# EasyEDA Pro project test_0.eprj

# Schematic Schematic1

## Sheets
1 P1: Board Name: Board1; Create Date: 2024-12-12; Page Name: P1; Project Name: test_0; Schematic Name: Schematic1; Update Date: 2025-06-09; Company: 嘉立创EDA; Page Size: A4; Version: V1.0
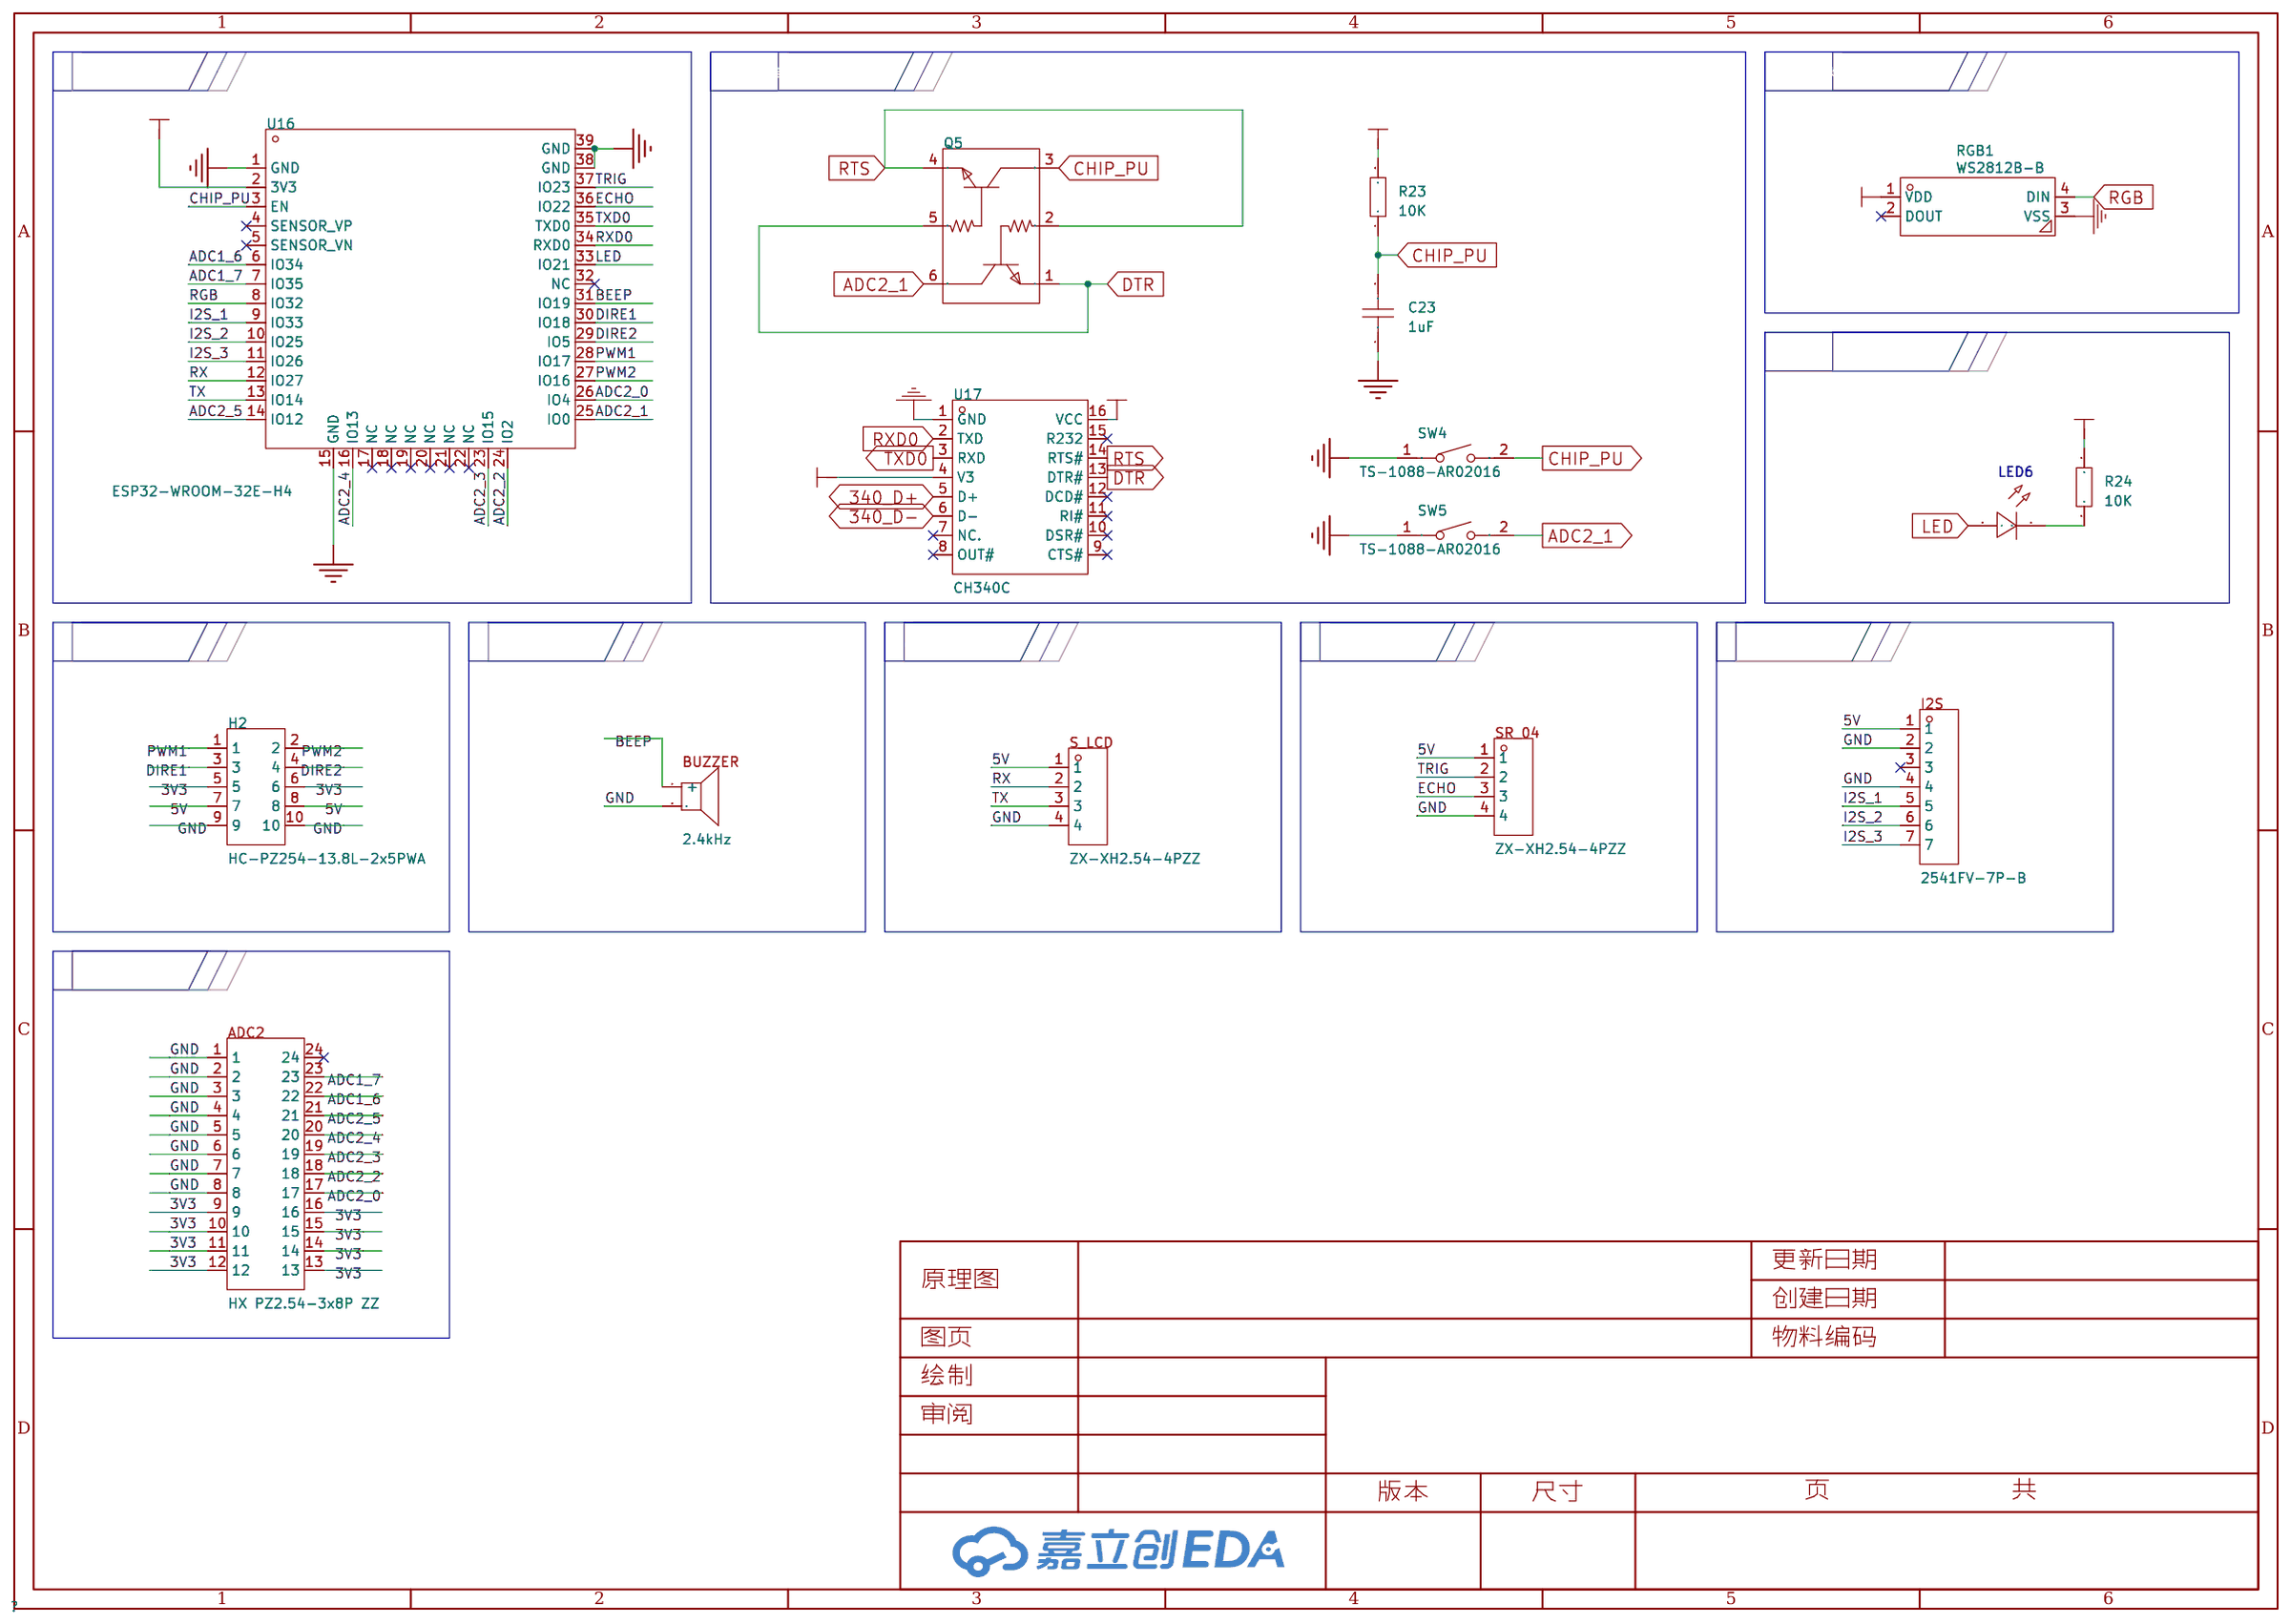
[diagram p0: P1]
2 P2: Create Date: 2024-12-15; Page Name: P2
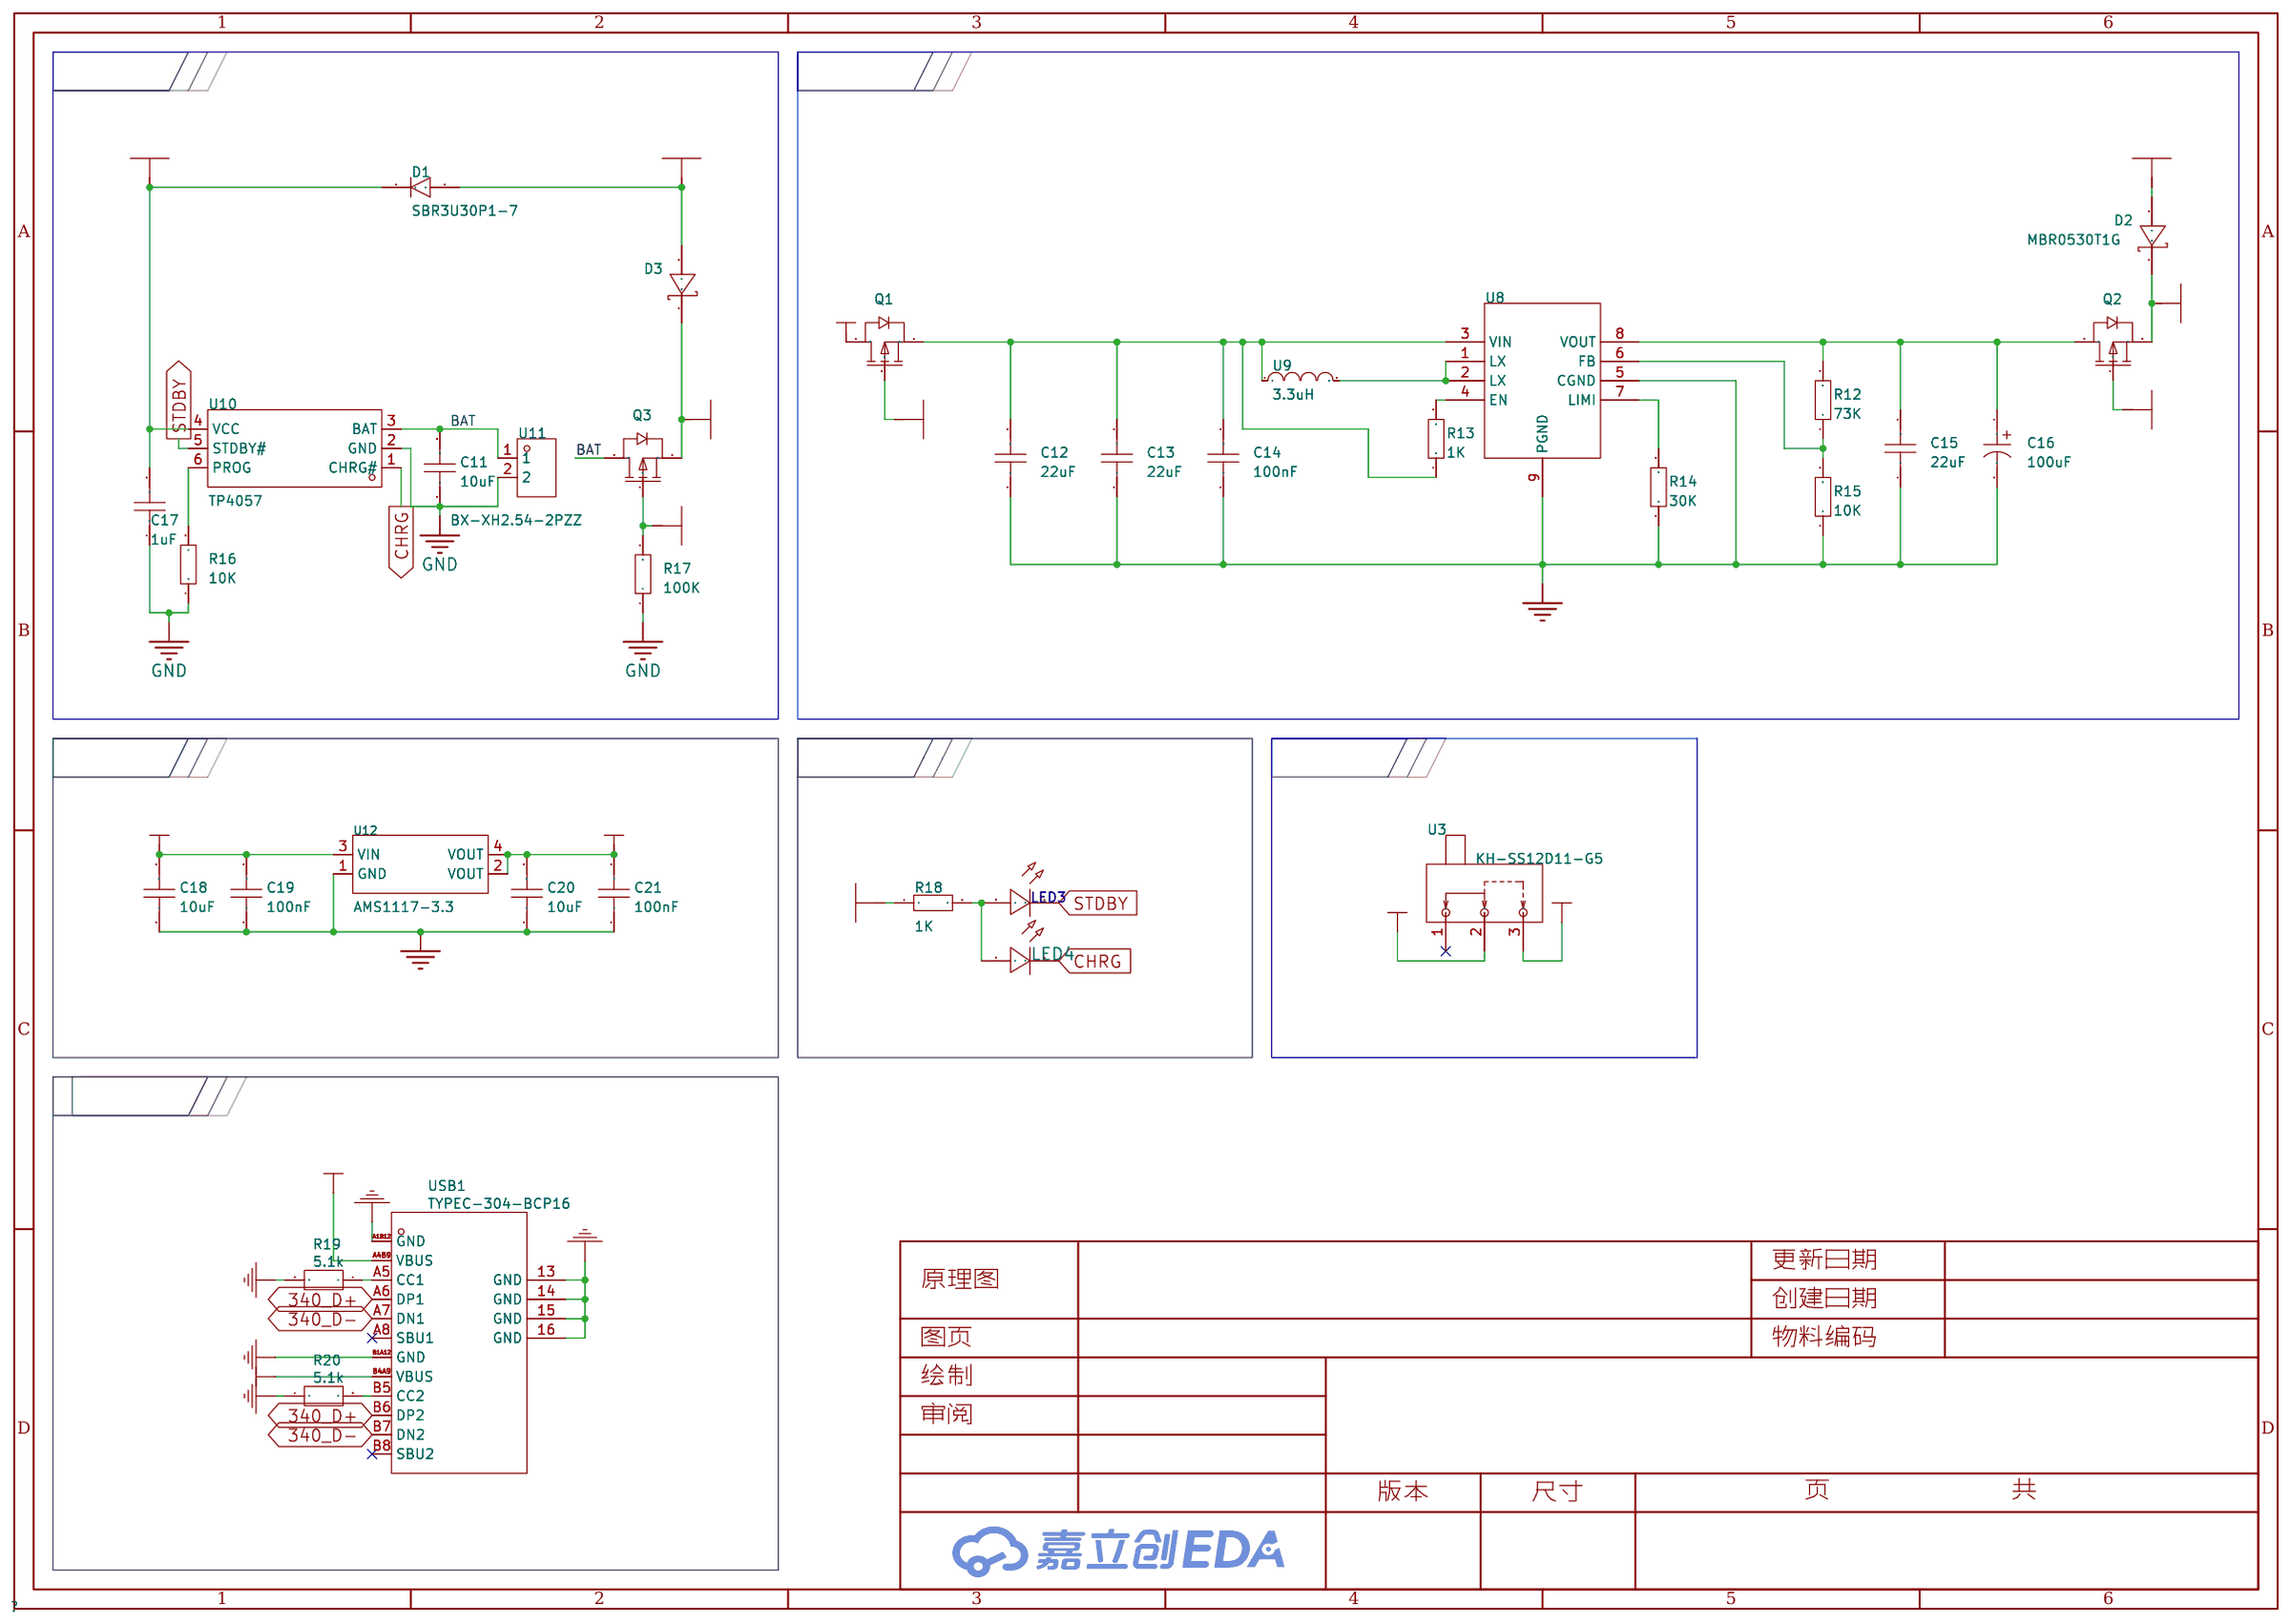
[diagram p1: P2]
3 P3: Create Date: 2025-01-15; Page Name: P3
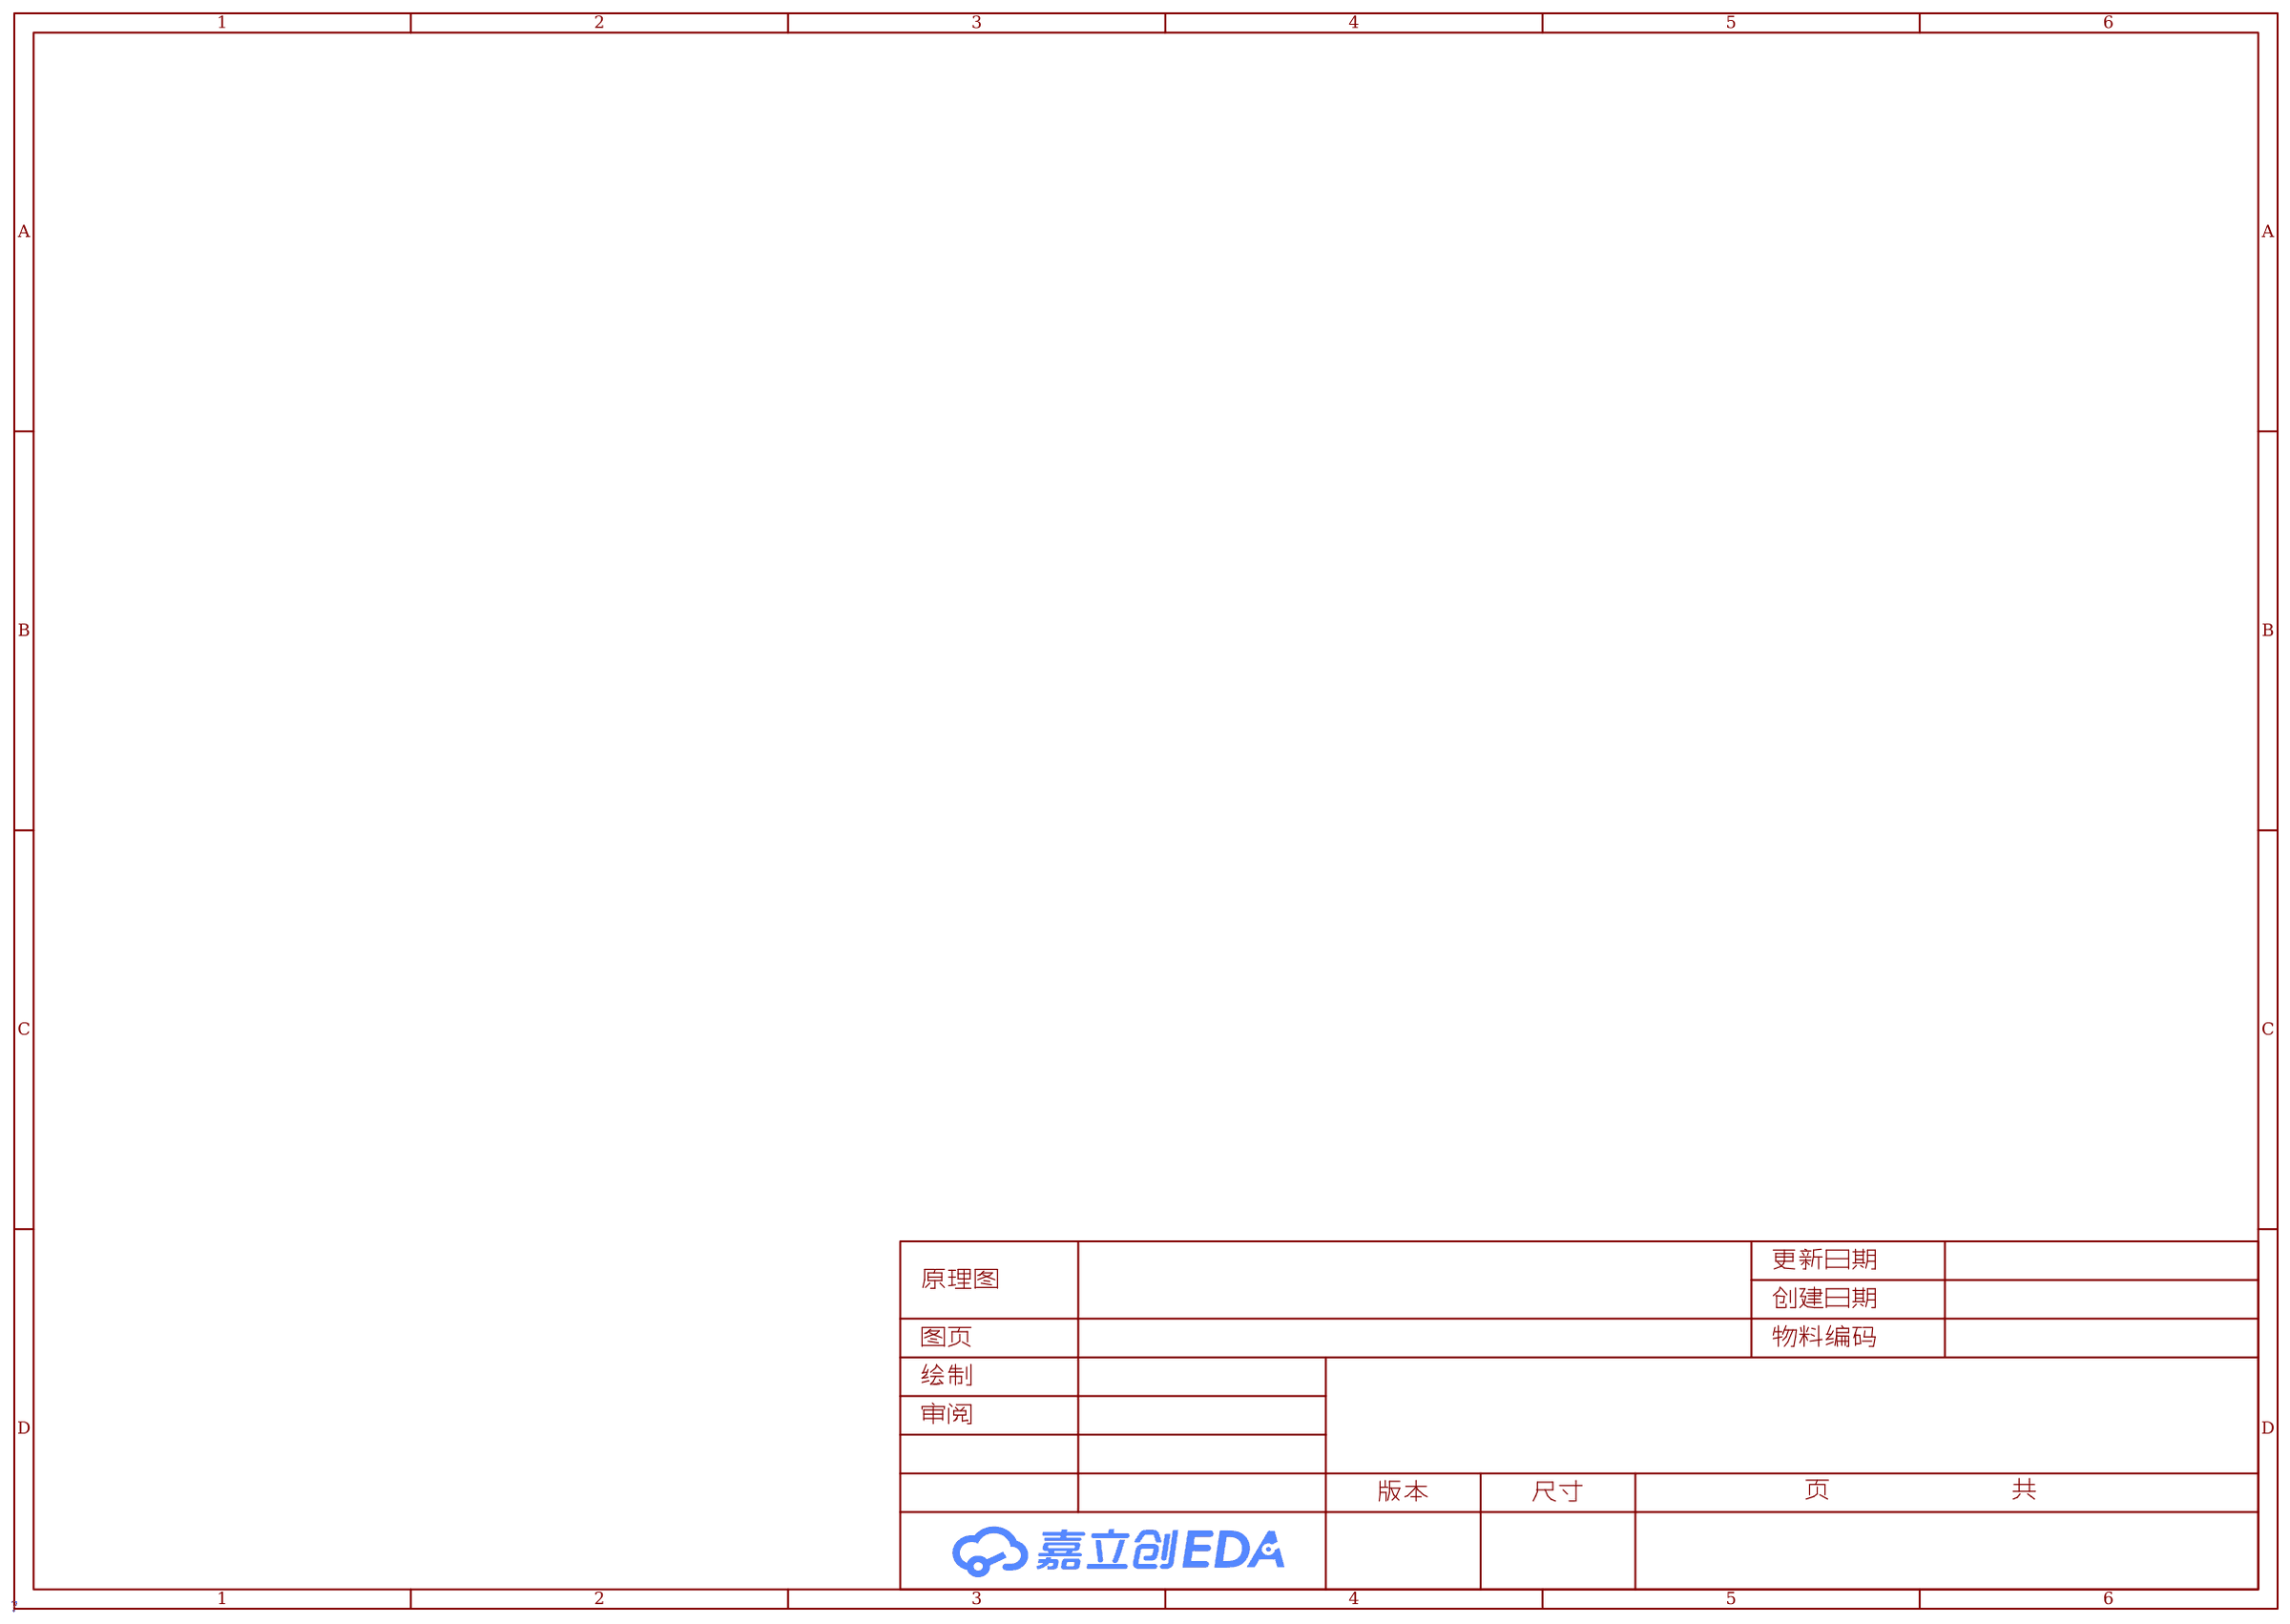
[diagram p2: P3]

## Parts
sheet P1
ADC2  HX PZ2.54-3x8P ZZ  [HDR-TH_24P-P2.54-V-M-R3-C8-S2.54_1]
BUZZER  2.4kHz  [BUZ-TH_BD12.0-P7.60-D0.6-FD]
C23  1uF  [C0805]
H2  HC-PZ254-13.8L-2x5PWA  [HDR-TH_10P-P2.54-H-M-R2-C5-S2.54-W9.7]
I2S  2541FV-7P-B  [HDR-TH_7P-P2.54-V-F]
LED6  -  [LED_0805]
Q5  UMH3N  [SC-70-6_L2.2-W1.3-P0.65-LS2.1-BR]
R23  10K  [R0805]
R24  10K  [R0805]
RGB1  WS2812B-B  [LED-SMD_4P-L5.0-W5.0-BL_TC5050RGB]
S_LCD  ZX-XH2.54-4PZZ  [CONN-TH_4P-P2.50_4PIN]
SR_04  ZX-XH2.54-4PZZ  [CONN-TH_4P-P2.50_4PIN]
SW4  TS-1088-AR02016  [SW-SMD_L3.9-W3.0-P4.45]
SW5  TS-1088-AR02016  [SW-SMD_L3.9-W3.0-P4.45]
U16  ESP32-WROOM-32E-H4  [WIFI-SMD_ESP32-WROOM-32E]
U17  CH340C  [SOP-16_L10.0-W3.9-P1.27-LS6.0-BL]
sheet P2
C11  10uF  [C0805]
C12  22uF  [C0805]
C13  22uF  [C0805]
C14  100nF  [C0805]
C15  22uF  [C0805]
C16  100uF  [CAP-TH_BD5.0-P2.00-D0.5-FD]
C17  1uF  [C0805]
C18  10uF  [C0805]
C19  100nF  [C0805]
C20  10uF  [C0805]
C21  100nF  [C0805]
D1  SBR3U30P1-7  [POWERDI-123_L2.8-W1.8-LS3.7-RD-1]
D2  MBR0530T1G  [SOD-123_L2.7-W1.6-LS3.7-RD-1]
D3  MBR0530T1G  [SOD-123_L2.7-W1.6-LS3.7-RD-1]
LED3  -  [LED_0805]
LED4  -  [LED_0805]
Q1  -  [SOT-23-3_L2.9-W1.3-P1.90-LS2.4-BR]
Q2  -  [SOT-23-3_L2.9-W1.3-P1.90-LS2.4-BR]
Q3  -  [SOT-23-3_L2.9-W1.3-P1.90-LS2.4-BR]
R12  73K  [R0805]
R13  1K  [R0805]
R14  30K  [R0805]
R15  10K  [R0805]
R16  10K  [R0805]
R17  100K  [R0805]
R18  1K  [R0805]
R19  5.1k  [R0805]
R20  5.1k  [R0805]
U3  KH-SS12D11-G5  [SW-TH_KH-SS12D11-G5]
U8  -  [ESOP-8_L4.9-W3.9-P1.27-LS6.0-BL-EP3.1-1]
U9  3.3uH  [IND-SMD_L7.0-W6.6]
U10  TP4057  [SOT-23-6_L2.9-W1.6-P0.95-LS2.8-BR]
U11  BX-XH2.54-2PZZ  [CONN-TH_2P-P2.50_BX-XH2.54-2PZZ]
U12  AMS1117-3.3  [SOT-223-3_L6.7-W3.7-P2.30-LS7.0-BR]
USB1  TYPEC-304-BCP16  [USB-C-SMD_TYPEC-304-BCP16]

## Library data of the parts
ADC2 = HX PZ2.54-3x8P ZZ: LCSC Part Name: 3x8P 间距:2.54mm 方针 直插; Supplier Part: C32713295; Manufacturer: hanxia(韩下); Supplier Footprint: 插件,P=2.54mm; JLCPCB Part Class: 扩展库; Datasheet: https://atta.szlcsc.com/upload/public/pdf/source/20240723/81BA62910452254F3F6A9430A78385C7.pdf; Supplier: LCSC; Pin Structure: 3x8P; Pitch: 2.54mm; Row Spacing: 2.54mm; Circluar Pins/Square Pins: 方针; Mounting Type: 直插; Number of Rows: 三排; Number of Pins: 24P; Current Rating: 3A; Length of Mating Pin: 6mm; Insulation Height: 2.5mm; Length of End Connection Pin: 3mm; Contact Material: 黄铜; Contact Plating: 金; Operating Temperature: -40℃~+105℃; Color: 黑色
BUZZER = TMB12A05_C96093: LCSC Part Name: TMB12A05; Supplier Part: C96093; Manufacturer: 华能; Manufacturer Part: TMB12A05; Supplier Footprint: 插件,D=12mm; JLCPCB Part Class: 扩展库; Datasheet: https://atta.szlcsc.com/upload/public/pdf/source/20241025/8A17FE04D767D19A35A06DEF9A82AB1E.pdf; Supplier: LCSC; Driver Circuitry: 有源(内含驱动线路); Technology: 电磁式; Voltage - Supply: 4V~8V; Sound Pressure Level(SPL): 85dB; Diameter(φD): 12mm; Height: 9.8mm
C11-C15 C17-C21 C23 = CAP_0805: Supplier Footprint: 0805
H2 = HC-PZ254-13.8L-2x5PWA: LCSC Part Name: 2x5P 间距:2.54mm 方针 弯插; Supplier Part: C27985207; Manufacturer: HC(虹成电子); Supplier Footprint: 弯插,P=2.54mm; JLCPCB Part Class: 扩展库; Datasheet: https://atta.szlcsc.com/upload/public/pdf/source/20250106/224C2C78CACEBA34A4AFC3D2C4BA02FD.pdf; Supplier: LCSC; Pin Structure: 2x5P; Pitch: 2.54mm; Row Spacing: 2.54mm; Circluar Pins/Square Pins: 方针; Mounting Type: 弯插; Number of Rows: 双排; Number of Pins: 10P; Current Rating: 3A; Length of Mating Pin: 6mm; Insulation Height: 5.04mm; Length of End Connection Pin: 3mm; Contact Material: 黄铜; Contact Plating: 金; Operating Temperature: -40℃~+105℃; Color: 黑色
I2S = 2541FV-7P-B: Supplier Part: C25503116; Manufacturer: HanElectricity(瀚源); Supplier Footprint: 插件,P=2.54mm; JLCPCB Part Class: 扩展库; Datasheet: https://atta.szlcsc.com/upload/public/pdf/source/20240704/2CCE49895ED08C95E19327B953741130.pdf; Supplier: LCSC
LED3 LED6 = LED_0805-G: Supplier Footprint: 0805
Q5 = UMH3N: 晶体管类型:2个NPN-预偏置;功率(Pd):150mW;集电极电流(Ic):100mA;集射极击穿电压(Vceo):50V;; LCSC Part Name: 2个NPN-预偏置 100mA 50V; Supplier Part: C62892; Manufacturer: CJ(江苏长电/长晶); Supplier Footprint: SC-70-6(SOT-363); JLCPCB Part Class: Extended Part; Datasheet: https://atta.szlcsc.com/upload/public/pdf/source/20151109/1457707575095.pdf; Supplier: LCSC; Transistor Type: 2个NPN-预偏置; Power Dissipation (Pd): 150mW; Collector Current (Ic): 100mA; Collector-Emitter Breakdown Voltage (Vceo): 50V
R12-R18 R23 R24 = Res_0805: Supplier Footprint: 0805
RGB1 = WS2812B-B: Supplier: LCSC; Manufacturer: worldsemi; Manufacturer Part: WS2812B-B/W; Supplier Part: C114586; JLCPCB Part Class: Extended Part; link: https://so.szlcsc.com/global.html?k=C114586&amp;ref=editor
S_LCD SR_04 = ZX-XH2.54-4PZZ: LCSC Part Name: 1x4P 间距:2.5mm 直插 系列:XH; Supplier Part: C7429634; Manufacturer: Megastar(兆星); Supplier Footprint: 插件,P=2.5mm; JLCPCB Part Class: 扩展库; Datasheet: https://atta.szlcsc.com/upload/public/pdf/source/20230619/B529A2163E0159A644AB3383D208FB03.pdf; Supplier: LCSC; Pins Structure: 1x4P; Pitch: 2.5mm; Mounting Type: 直插; Reference Series: XH; Number of Pins: 4P; Number of Rows: 1; Number of PINs Per Row: 4; Rated Current: 3A; Contact Material: 黄铜; Contact Plating: 锡; Operating Temperature: -25℃~+85℃; Rated Voltage (Max): 250V; Plastic Material: PA66; Flame Retardant Rating: UL94V-0; Color: 白色; Z-Height of the Board: 7mm; X-Length of Bottom Edge on Board (Spacing Line): 12.5mm; Y-Width of Bottom Edge on Board: 5.9mm
SW4 SW5 = TS-1088-AR02016: 电路结构:单刀单掷;按钮形状:圆形按钮;作用力:160gf;安装方式:立贴;开关长度:4mm;开关宽度:3mm;开关高度:2mm;带支架:不带;触点电流:50mA;额定电压(DC):12V;绝缘电阻:100MΩ;机械寿命:10万次;; LCSC Part Name: 4*3*2mm 立贴 轻触开关; Supplier Part: C720477; Manufacturer: XUNPU(讯普); Supplier Footprint: SMD; Datasheet: https://atta.szlcsc.com/upload/public/pdf/source/20200810/C720475_60D09DD6C54279ADDB2DC25100F1CC11.pdf; Supplier: LCSC; Circuit: 单刀单掷; Actuator Style: 圆形按钮; Operating Force: 160gf; Mounting Style: 立贴; Switch Length: 4mm; Switch Width: 3mm; Switch Height: 2mm; Strike Gundam: 不带; Contact Current: 50mA; Voltage Rating (DC): 12V; Insulation Resistance: 100MΩ; Actuator/Cap Color: 黑色; Pin Style: SMD接片; Mechanical Life: 10万次; Operating Temperature: -30℃~+80℃
U16 = ESP32-WROOM-32E-H4: 命名更改，4MB即H4，为尾缀，模组丝印更改为H4，H为高温105°C，软硬件无更改; Supplier Part: C3013935; Manufacturer: ESPRESSIF(乐鑫); Supplier Footprint: SMD,18x25.5mm; Datasheet: https://atta.szlcsc.com/upload/public/pdf/source/20220506/2B7DF1E5B41DABC7447F735C715CAF22.pdf; Supplier: LCSC
U17 = CH340C: 应用功能:收发器;接口协议:USB 2.0;数据速率:2Mbps;; LCSC Part Name: CH340C USB转串口芯片 CH340; Supplier Part: C84681; Manufacturer: WCH(南京沁恒); Supplier Footprint: SOP-16; Datasheet: https://atta.szlcsc.com/upload/public/pdf/source/20200819/C84681_ADBED554CE321879DBD6B1D06488689C.pdf; Supplier: LCSC; Applications Function: 收发器; Protocol: USB 2.0; Supply Voltage: 3.3V；5V; Data Rate: 2Mbps
C16 = UFW1C101MDD1TD: 容值:100uF;精度:±20%;额定电压:16V;纹波电流:155mA@120Hz;; LCSC Part Name: 100uF ±20% 16V; Supplier Part: C1579345; Manufacturer: Nichicon(尼吉康); Supplier Footprint: 插件; Datasheet: https://atta.szlcsc.com/upload/public/pdf/source/20240311/7EB34D233ACCD34112698C000C3073DF.pdf; Supplier: LCSC; Tolerance: ±20%; Rated Voltage: 16V; Ripple Current: 155mA@120Hz; Lead Spacing: 2.5mm; φD: 5mm; Lifetime @ Temp: 2000hrs@85℃; Operating Temperature: -40℃~+85℃
D1 = SBR3U30P1-7: 二极管配置:-;正向压降(Vf):390mV@3A;直流反向耐压(Vr):30V;平均整流电流(Io):3A;; LCSC Part Name: 电压:30V 电流:3A; Supplier Part: C110517; Manufacturer: DIODES(美台); Supplier Footprint: PowerDI-123; Datasheet: https://atta.szlcsc.com/upload/public/pdf/source/20170427/1493286400908.pdf; Supplier: LCSC; Forward Voltage (Vf) @ If: 390mV@3A; Reverse Voltage (Vr): 30V; Average Rectified Current (Io): 3A; Reverse Leakage Current: 150uA@30V
D2 D3 = MBR0530T1G: 正向压降(Vf):430mV@500mA;直流反向耐压(Vr):30V;平均整流电流(Io):500mA;; LCSC Part Name: 电压:30V 电流:500mA; Supplier Part: C82046; Manufacturer: onsemi(安森美); Supplier Footprint: SOD-123; Datasheet: https://atta.szlcsc.com/upload/public/pdf/source/20190903/C236079_423CC232CDF653D3C1D51633B66DAE1D.pdf; Supplier: LCSC; Forward Voltage (Vf@If): 430mV@500mA; Reverse Voltage (Vr): 30V; Average Rectified Current (Io): 500mA; Reverse Leakage Current (Ir): 130uA@30V
LED4 = LED_0805-R: Supplier Footprint: 0805
Q1-Q3 = AO3401A: 类型:P沟道;漏源电压(Vdss):30V;连续漏极电流(Id):4.2A;功率(Pd):1W;导通电阻(RDS(on)@Vgs,Id):65mΩ@10V,3A;阈值电压(Vgs(th)@Id):1.5V@250A;; LCSC Part Name: P沟道 30V 4.2A; Supplier Part: C700954; Manufacturer: HUASHUO(华朔); Supplier Footprint: SOT-23; JLCPCB Part Class: Extended Part; Datasheet: https://atta.szlcsc.com/upload/public/pdf/source/20200713/C700954_50D0EF28D145CDC0B45B48010B096AD0.pdf; Supplier: LCSC; Type: P沟道; Drain Source Voltage (Vdss): 30V; Continuous Drain Current (Id): 4.2A; Power Dissipation (Pd): 1W; Drain Source On Resistance (RDS(on)@Vgs,Id): 65mΩ@10V,3A; Gate Threshold Voltage (Vgs(th)@Id): 1.5V@250A
R19 R20 = 5.1k: link: https://item.szlcsc.com/142685.html; 3DModel: R0805_L2.0-W1.3-H0.6
U3 = KH-SS12D11-G5: LCSC Part Name: 拨动开关 KH-SS12D11-G5; Supplier Part: C5274459; Manufacturer: kinghelm(金航标); Supplier Footprint: 插件; Datasheet: https://atta.szlcsc.com/upload/public/pdf/source/20221118/D3EA06F056896B32E96D61E050F18673.pdf; Supplier: LCSC
U8 = PW5303
U9 = XR0630-3R3M: 电感值:3.3uH;精度:±20%;额定电流:8.5A;饱和电流(Isat):9.5A;类型:一体成型电感;; LCSC Part Name: 3.3uH ±20% 9.5A; Supplier Part: C5307629; Manufacturer: XR(祥如); Supplier Footprint: SMD,0630; Datasheet: https://atta.szlcsc.com/upload/public/pdf/source/20240328/E34CB2E38BB86D6F3C49FFE3A7D9A071.pdf; Supplier: LCSC; Tolerance: ±20%; Rated Current: 8.5A; Saturation Current (Isat): 9.5A; DC Resistance (DCR): 22mΩ; Type: 一体成型电感
U10 = TP4057: 电源电压:6.5V;最大充电电流:500mA;电池类型:锂离子/聚合物;电池节数:1;; Supplier Part: C725791; Manufacturer: UMW(友台半导体); Supplier Footprint: SOT-23-6; Datasheet: https://atta.szlcsc.com/upload/public/pdf/source/20231109/7FB39B0490CD1514A6792371FCA0BB30.pdf; Supplier: LCSC; Supply Voltage: 6.5V; Maximum Charge Current: 500mA; Type of Battery: 锂离子/聚合物; Number of Cells: 1; Operating Temperature: -40℃~+85℃
U11 = BX-XH2.54-2PZZ: 插针结构:1x2P;间距:2.54mm;安装方式:直插;参考系列:XH;总PIN数:2P;排数:1;每排PIN数:2;行距:-;额定电流:3A;触头材质:黄铜;触头镀层:锡;工作温度范围:-25℃~+85℃;; Supplier Part: C18077833; Manufacturer: Bossie(博锡); Supplier Footprint: 插件,P=2.54mm; Datasheet: https://atta.szlcsc.com/upload/public/pdf/source/20231017/CB25E46A13930659CD6CDE2F2553A508.pdf; Supplier: LCSC; Pins Structure: 1x2P; Pitch: 2.54mm; Mounting Style: 直插; Reference Series: XH; Number of Pins: 2P; Number of Rows: 1; Number of PINs Per Row: 2; Current Rating (Max): 3A; Contact Material: 黄铜; Contact Plating: 锡; Operating Temperature Range: -25℃~+85℃
U12 = AMS1117-3.3_C18164485: 输出类型:固定;最大输入电压:18V;输出电压:3.3V;最大输出电流:1A;电源纹波抑制比(PSRR):60dB@(120Hz);输出极性:正极;; Supplier Part: C18164485; Manufacturer: GR(国睿); Supplier Footprint: SOT-223; Datasheet: https://atta.szlcsc.com/upload/public/pdf/source/20230915/94CBA0DE456537EBE1AFE762E38F0E43.pdf; Supplier: LCSC; Output Type: 固定; Maximum Input Voltage: 18V; Output Voltage: 3.3V; MAX Output Current: 1A; Power Supply Rejection Ratio (PSRR): 60dB@(120Hz); Output Polarity: 正极
USB1 = TYPEC-304-BCP16: link: https://item.szlcsc.com/763636.html?ref=editor&logined=true; Supplier: LCSC; Supplier Part: C720629; Manufacturer: XUNPU(讯普); JLCPCB Part Class: Extended Part

## Nets
3V3: ADC2.9 ADC2.10 ADC2.11 ADC2.12 ADC2.13 ADC2.14 ADC2.15 ADC2.16 C20.2 C21.2 H2.5 H2.6 R23.2 R24.2 RGB1.1(VDD) U12.2(VOUT) U12.4(VOUT) U16.2(3V3) U17.4(V3) U17.16(VCC)
5V: C18.2 C19.2 D2.1(C) H2.7 H2.8 I2S.1 Q2.2(S) S_LCD.1 SR_04.1 U12.3(VIN)
GND: ADC2.1 ADC2.2 ADC2.3 ADC2.4 ADC2.5 ADC2.6 ADC2.7 ADC2.8 BUZZER.2 C11.1 C12.1 C13.1 C14.1 C15.1 C16.2 C17.1 C18.1 C19.1 C20.1 C21.1 C23.1 H2.9 H2.10 I2S.2 I2S.4 R14.1 R15.1 R16.1 R17.1 R19.2 R20.1 RGB1.3(VSS) S_LCD.4 SR_04.4 SW4.1 SW5.1 U8.5(CGND) U8.9(PGND) U10.2(GND) U11.2 U12.1(GND) U16.1(GND) U16.15(GND) U16.38(GND) U16.39(GND) U17.1(GND) USB1.13(GND) USB1.14(GND) USB1.15(GND) USB1.16(GND) USB1.A1B12(GND) USB1.B1A12(GND)
VBUS: D1.2(C) D3.2(A) Q1.1(G) Q2.1(G) Q3.1(G) R17.2 USB1.A4B9(VBUS) USB1.B4A9(VBUS)
VBUSIN: D3.1(C) Q3.2(S) U3.3
VCC: C17.2 D1.1(A) R18.1 U10.4(VCC)
VIN: D2.2(A) Q1.3(D) U3.2
340_D+: U17.5(D+) USB1.A6(DP1) USB1.B6(DP2)
340_D-: U17.6(D-) USB1.A7(DN1) USB1.B7(DN2)
ADC1_6: ADC2.22 U16.6(IO34)
ADC1_7: ADC2.23 U16.7(IO35)
ADC2_0: ADC2.17 U16.26(IO4)
ADC2_1: Q5.6(C) SW5.2 U16.25(IO0)
ADC2_2: ADC2.18 U16.24(IO2)
ADC2_3: ADC2.19 U16.23(IO15)
ADC2_4: ADC2.20 U16.16(IO13)
ADC2_5: ADC2.21 U16.14(IO12)
BAT: C11.2 Q3.3(D) U10.3(BAT) U11.1
BEEP: BUZZER.1(+) U16.31(IO19)
CHIP_PU: C23.2 Q5.3(C) R23.1 SW4.2 U16.3(EN)
CHRG: LED4.1(C) U10.1(CHRG#)
DIRE1: H2.3 U16.30(IO18)
DIRE2: H2.4 U16.29(IO5)
DTR: Q5.1(E) Q5.5(B) U17.13(DTR#)
ECHO: SR_04.3 U16.36(IO22)
I2S_1: I2S.5 U16.9(IO33)
I2S_2: I2S.6 U16.10(IO25)
I2S_3: I2S.7 U16.11(IO26)
LED: LED6.2(A) U16.33(IO21)
PWM1: H2.1 U16.28(IO17)
PWM2: H2.2 U16.27(IO16)
RGB: RGB1.4(DIN) U16.8(IO32)
RTS: Q5.2(B) Q5.4(E) U17.14(RTS#)
RX: S_LCD.2 U16.12(IO27)
RXD0: U16.34(RXD0) U17.2(TXD)
STDBY: LED3.1(C) U10.5(STDBY#)
TRIG: SR_04.2 U16.37(IO23)
TX: S_LCD.3 U16.13(IO14)
TXD0: U16.35(TXD0) U17.3(RXD)
$2N227: U8.1(LX) U8.2(LX) U9.2
$2N228: C12.2 C13.2 C14.2 Q1.2(S) R13.1 U8.3(VIN) U9.1
$2N230: R13.2 U8.4(EN)
$2N472: R14.2 U8.7(LIMI)
$2N473: R12.1 R15.2 U8.6(FB)
$2N477: C15.2 C16.1 Q2.3(D) R12.2 U8.8(VOUT)
$2N943: R19.1 USB1.A5(CC1)
$2N948: R20.2 USB1.B5(CC2)
$2N1528: R16.2 U10.6(PROG)
$2N1721: LED3.2(A) LED4.2(A) R18.2
Net-(LED6-1): LED6.1(C) R24.1